# EasyEDA Pro project C108_STM32.eprj, board PCB2
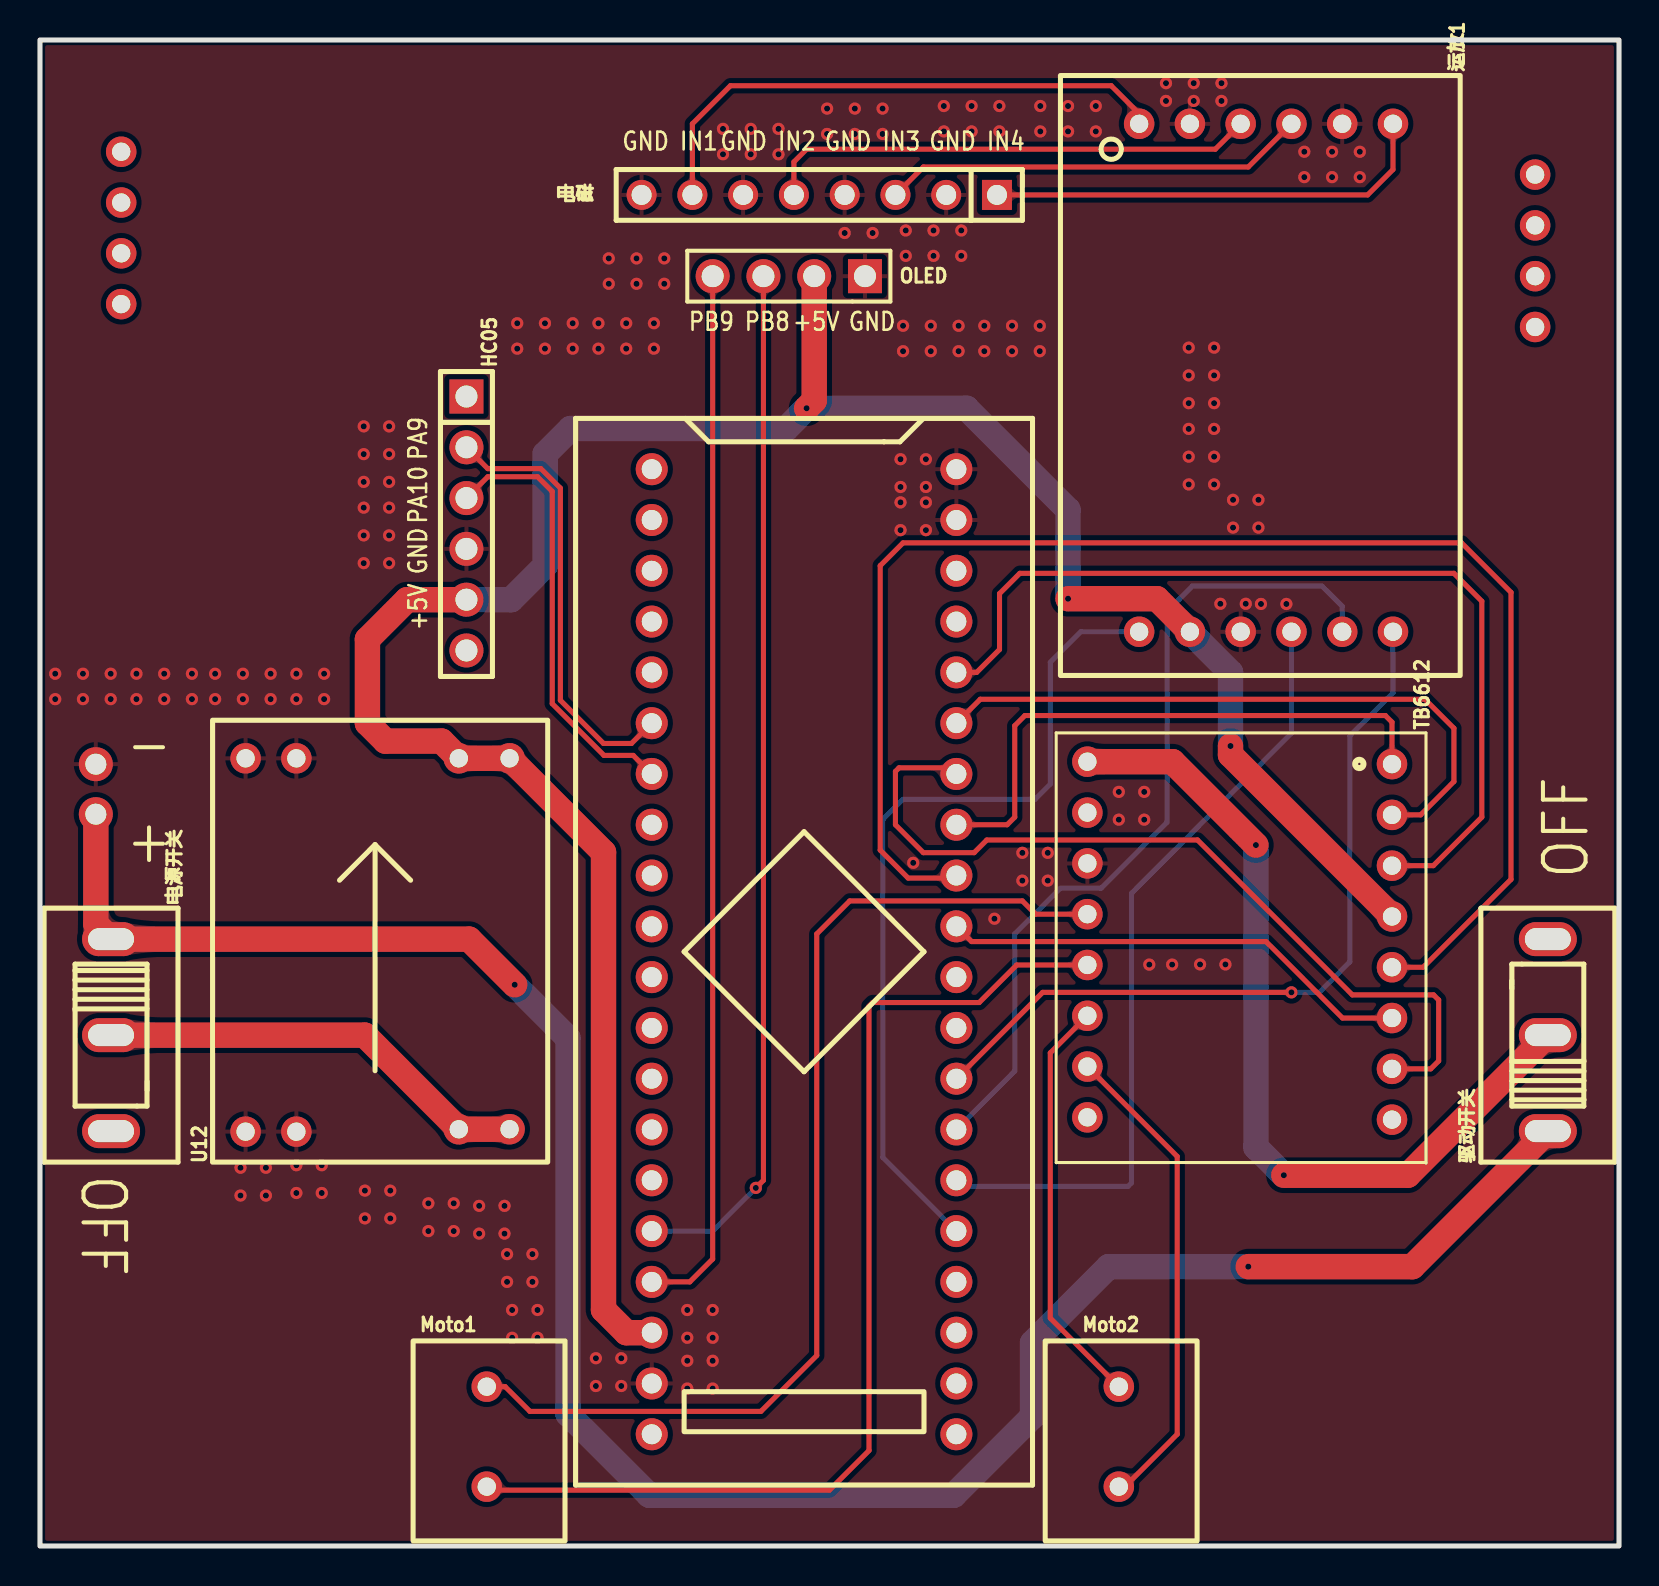
[diagram p11: board, top side]
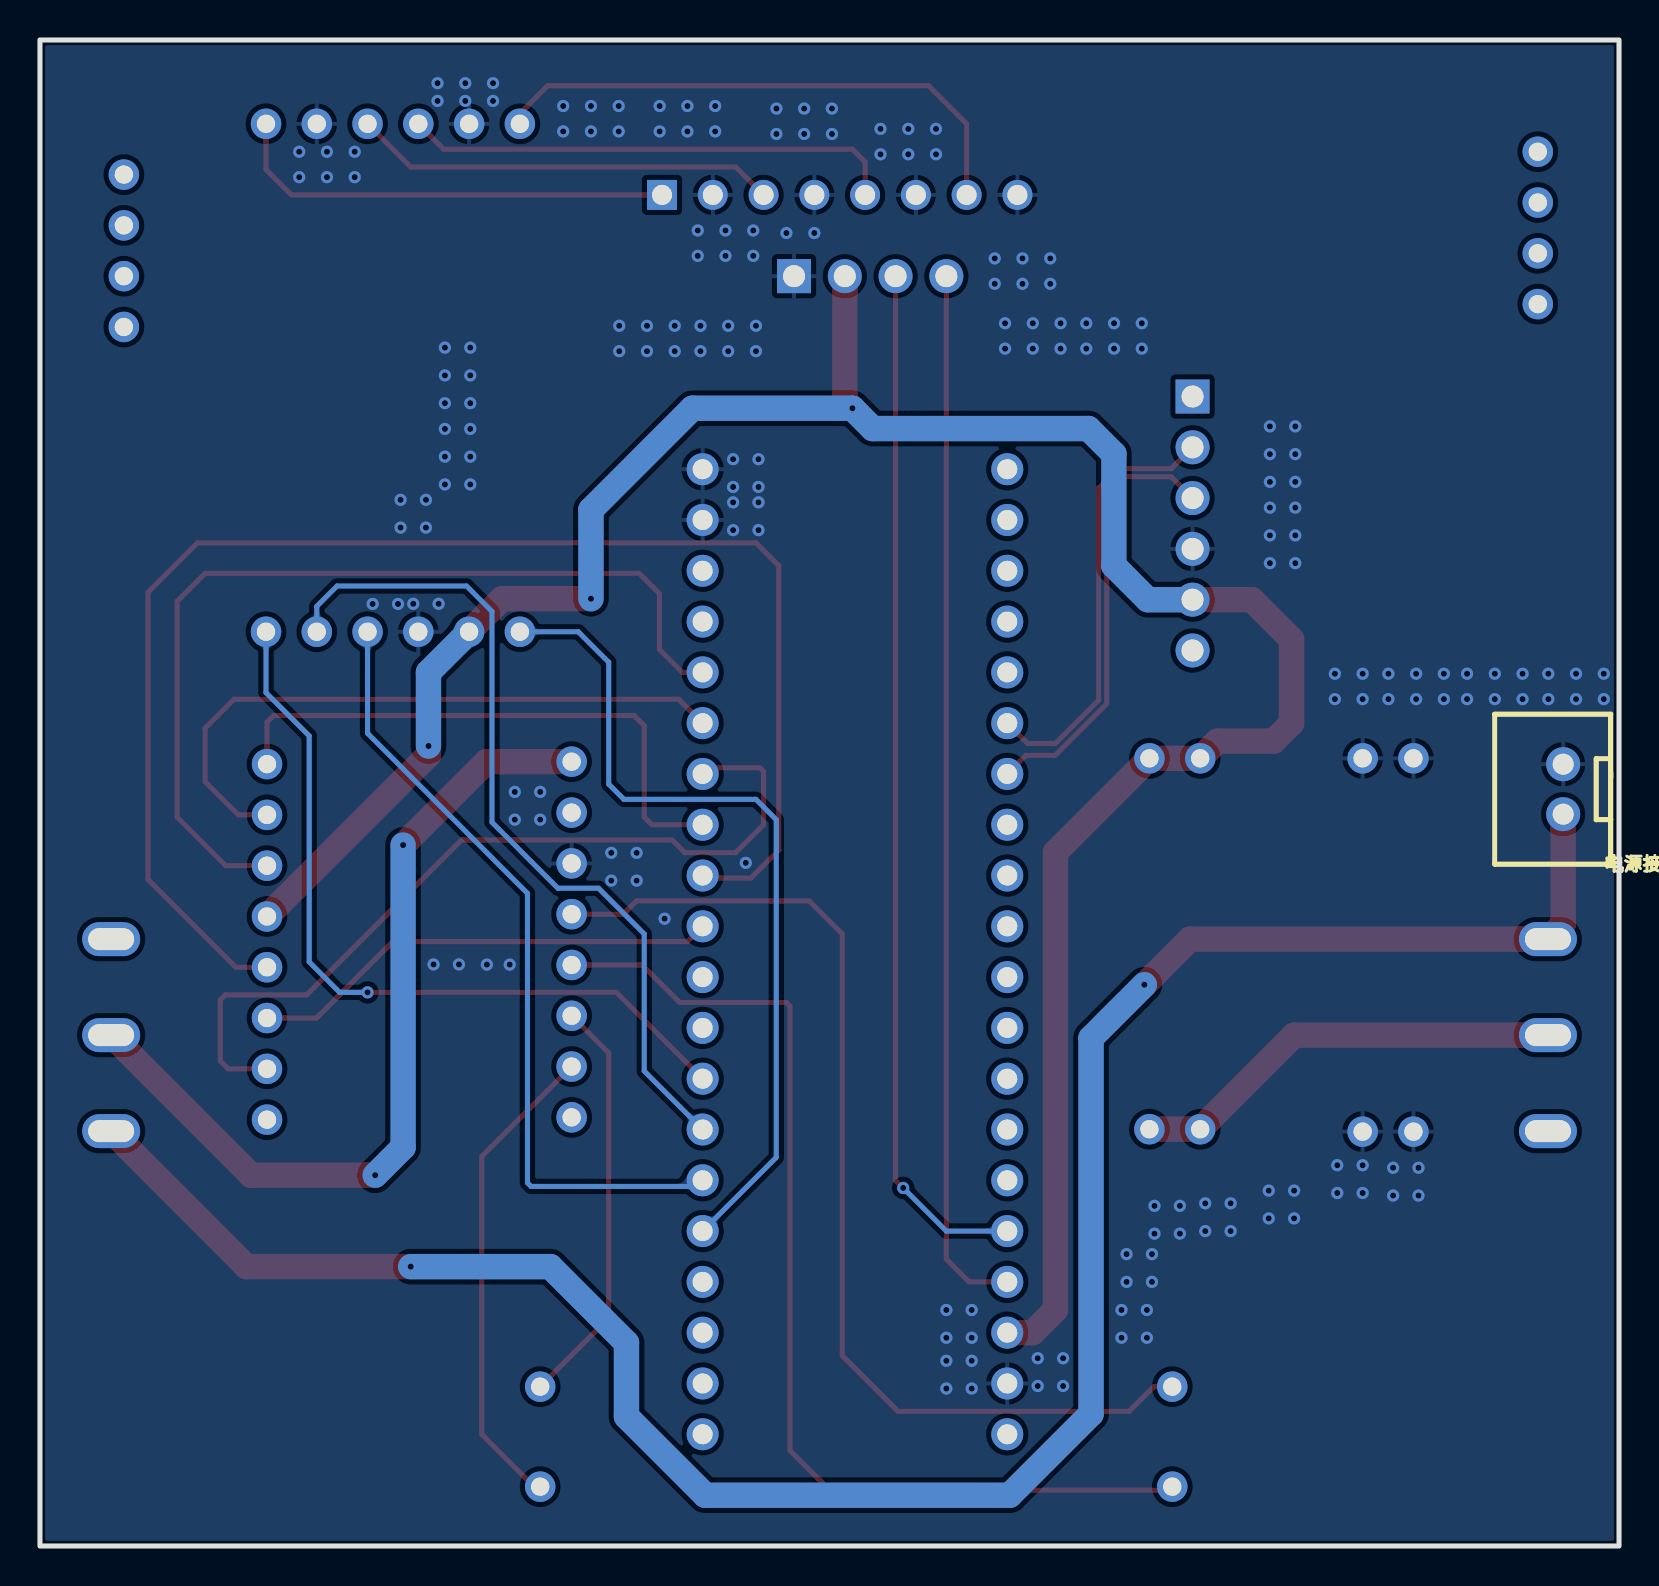
[diagram p12: board, bottom side, seen from below]

Outline 79 x 75.31 mm; copper layers: Top Layer, Bottom Layer. Coordinates in mm from the lower left corner of the outline.
Outline path: rectangle 0,75.31 79,0
Stack: Top Layer 0.035mm / Dielectric1 1.51mm FR4 er 4.5 / Bottom Layer 0.035mm

## Design rules (mm)
net PA9: DP1
net PA10: DP1
template: JLCPCB Capability(Two Layers Board)
spacing copperThickness1oz (default): track to track 0.102, other pairs 0.152 to 0.3
spacing copperThickness2oz: track to track 0.203, other pairs 0.152 to 0.3
track width copperThickness1oz (default): min 0.127, default 0.254, max 2.54
track width copperThickness2oz: min 0.203, default 0.254, max 2.54
differential pair differentialPair (default): width min 0.127, default 0.254, max 2.54; gap min 0.152, default 0.152
via viaSize (default): diameter min 0.5, default 0.61, max 10; hole min 0.3, default 0.305, max 6.3

## Placement (name value [footprint] x y rotation side)
HC05  HC05  [HDR-TH_6P-P2.54-V-M]  21.34 51.13 270 top
Moto1  -  [端子]  18.54 10.13 270 top
Moto2  -  [端子]  50.17 10.13 270 top
NOREF  -  [Pad_e28]  74.8 68.58 0 top
NOREF#2  -  [Pad_e19]  4.06 67.18 0 top
NOREF#3  -  [Pad_e20]  4.06 64.64 0 top
NOREF#4  -  [Pad_e18]  4.06 69.72 0 top
NOREF#5  -  [Pad_e30]  74.8 63.5 0 top
NOREF#6  -  [Pad_e22]  4.06 62.1 0 top
NOREF#7  -  [Pad_e29]  74.8 60.96 0 top
NOREF#8  -  [Pad_e31]  74.8 66.04 0 top
OLED  0.96 OLED  [HDR-TH_4P-P2.54-V-M-1]  37.46 63.5 180 top
TB6612  -  [TB6612_Board]  59.69 42.16 270 top
U1  STM32F103C8T6-Card  [CONN-TH_L53.3-W22.9_STM32F103C8T6-CARD]  38.23 29.72 270 top
U12  -  [降压mini]  16.38 30.5 90 top
电源开关  电源开关  [SW-TH_SHOU-HAN_SS12D10G4]  3.56 25.55 270 top
电源接口  XH2.54*2P_直插  [CONN-TH_2P-P2.50-XH2.54-2P]  2.79 37.85 270 bottom
电磁  电感  [HDR-TH_8P-P2.54-V-M]  38.99 67.56 180 top
运放1  -  [逐飞运放]  50.93 73.66 270 top
驱动开关  驱动开关  [SW-TH_SHOU-HAN_SS12D10G4]  75.44 25.55 90 top

## Footprints (pads in the part's own frame, mm; a bottom-side part is the same pattern mirrored in y, then rotated)
CONN-TH_2P-P2.50-XH2.54-2P
  round 1.7 hole 1.05: 1(1.25,0) 2(-1.25,0)
CONN-TH_L53.3-W22.9_STM32F103C8T6-CARD
  round 1.6 hole 1: 1(-24.13,-7.62) 2(-21.59,-7.62) 3(-19.05,-7.62) 4(-16.51,-7.62) 5(-13.97,-7.62) 6(-11.43,-7.62) 7(-8.89,-7.62) 8(-6.35,-7.62) 9(-3.81,-7.62) 10(-1.27,-7.62) 11(1.27,-7.62) 12(3.81,-7.62) 13(6.35,-7.62) 14(8.89,-7.62) 15(11.43,-7.62) 16(13.97,-7.62) 17(16.51,-7.62) 18(19.05,-7.62) 19(21.59,-7.62) 20(24.13,-7.62) 21(24.13,7.62) 22(21.59,7.62) 23(19.05,7.62) 24(16.51,7.62) 25(13.97,7.62) 26(11.43,7.62) 27(8.89,7.62) 28(6.35,7.62) 29(3.81,7.62) 30(1.27,7.62) 31(-1.27,7.62) 32(-3.81,7.62) 33(-6.35,7.62) 34(-8.89,7.62) 35(-11.43,7.62) 36(-13.97,7.62) 37(-16.51,7.62) 38(-19.05,7.62) 39(-21.59,7.62) 40(-24.13,7.62)
HDR-TH_4P-P2.54-V-M-1
  rect 1.7x1.7 hole 1.1: 1(-3.81,0)
  round 1.7 hole 1.1: 2(-1.27,0) 3(1.27,0) 4(3.81,0)
HDR-TH_6P-P2.54-V-M
  rect 1.7x1.7 hole 1.1: 1(-6.35,0)
  round 1.7 hole 1.1: 2(-3.81,0) 3(-1.27,0) 4(1.27,0) 5(3.81,0) 6(6.35,0)
HDR-TH_8P-P2.54-V-M
  rect 1.5x1.5 hole 1: 1(-8.89,0)
  round 1.5 hole 1: 2(-6.35,0) 3(-3.81,0) 4(-1.27,0) 5(1.27,0) 6(3.81,0) 7(6.35,0) 8(8.89,0)
Pad_e18
  round 1.524 hole 0.914: 1(0,0)
Pad_e19
  round 1.524 hole 0.914: 2(0,0)
Pad_e20
  round 1.524 hole 0.914: 3(0,0)
Pad_e22
  round 1.524 hole 0.914: 4(0,0)
Pad_e28
  round 1.524 hole 0.914: 1(0,0)
Pad_e29
  round 1.524 hole 0.914: 4(0,0)
Pad_e30
  round 1.524 hole 0.914: 3(0,0)
Pad_e31
  round 1.524 hole 0.914: 2(0,0)
SW-TH_SHOU-HAN_SS12D10G4
  oval 1.7x2.9 hole 1.1x2.3: 1(-4.8,0) 2(0,0) 3(4.8,0)
TB6612_Board
  round 1.524 hole 0.914: 1(3.063,7.952) 2(5.603,7.952) 3(8.143,7.952) 4(10.683,7.952) 5(13.223,7.952) 6(15.763,7.952) 7(18.303,7.952) 8(20.843,7.952) 9(20.729,-7.288) 10(18.189,-7.288) 11(15.649,-7.288) 12(13.108,-7.288) 13(10.569,-7.288) 14(8.028,-7.288) 15(5.489,-7.288) 16(2.942,-7.288)
端子
  round 1.524 hole 0.914: 1(2.159,3.81) 2(7.159,3.81)
逐飞运放
  round 1.524 hole 0.914: 1(2.54,4.064) 2(2.54,6.604) 3(2.54,9.144) 4(2.54,11.684) 5(2.54,14.224) 6(2.54,16.764) 7(27.94,4.064) 8(27.94,6.604) 9(27.94,9.144) 10(27.94,11.684) 11(27.94,14.224) 12(27.94,16.764)
降压mini
  round 1.524 hole 0.914: 1(-9.779,6.096) 2(-9.779,3.556) 3(-9.659,-4.571) 4(-9.656,-7.112) 5(8.89,6.096) 6(8.89,3.556) 7(8.89,-4.571) 8(8.89,-7.112)

## Nets
As in the schematic, except:
GND: HC05.4 OLED.1 TB6612.14 U1.19 U1.39 U1.40 U12.1 U12.2 U12.5 U12.6 电源接口.2 电磁.2 电磁.4 电磁.6 电磁.8 运放1.2 运放1.5 运放1.9
$1N871: Moto1.2 TB6612.12
$1N884: 电磁.7 运放1.1
$1N885: 电磁.5 运放1.3
$1N886: 电磁.3 运放1.4
$1N887: 电磁.1 运放1.6
$1N1112: U12.3 U12.4 电源开关.2

Pads without a net: HC05 1 6; NOREF 1; NOREF#2 2; NOREF#3 3; NOREF#4 1; NOREF#5 3; NOREF#6 4; NOREF#7 4; NOREF#8 2; TB6612 8 9 15; U1 20 21 37 38; 电源开关 3; 驱动开关 3

## Via types
v1: diameter 0.61, hole 0.305, Top Layer to Bottom Layer, 199 vias

## Routing (per net, layer and track width the routed paths; a pad name or vN(x,y) marks a point on that pad's centre or on a via; arc(x,y) is an arc through that point)
12V+: length 110.7
  Top Layer w1.27: 驱动开关.1 68.66,13.97 v1(60.45,13.97) ; 电源接口.1 2.79,31.11 电源开关.1 21.47,30.35 v1(23.75,28.07)
  Bottom Layer w1.27: v1(23.75,28.07) 26.42,25.4 26.42,6.6 30.48,2.54 45.72,2.54 49.66,6.48 49.66,10.16 53.47,13.97 v1(60.45,13.97)
+5V: length 126.1
  Top Layer w1.27: U1.18 29.34,10.67 28.19,11.81 28.19,34.69 U12.8 U12.7 20.09,40.25 17.28,40.25 16.38,41.15 16.38,45.34 18.37,47.32 HC05.5 ; 57.53,45.72 55.88,47.37 v1(51.43,47.37) ; OLED.2 38.73,57.28 v1(38.35,56.9) ; TB6612.4 59.56,39.56 v1(59.56,40)
  Bottom Layer w1.27: 57.53,45.72 59.56,43.69 v1(59.56,40) ; v1(51.43,47.37) 51.43,51.82 46.36,56.9 v1(38.35,56.9) 37.34,55.88 26.54,55.88 25.27,54.61 25.27,49.02 23.57,47.32 HC05.5
GND:
  vias: v1(0.76,43.62) v1(0.76,42.35) v1(2.15,43.62) v1(2.15,42.35) v1(3.54,43.62) v1(3.54,42.35) v1(4.83,43.62) v1(4.83,42.35) v1(6.21,43.62) v1(6.21,42.35) v1(7.6,43.62) v1(7.6,42.35) v1(8.76,43.62) v1(8.76,42.35) v1(10.03,18.91) v1(10.03,17.53) v1(10.15,43.62) v1(10.15,42.35) v1(11.3,18.91) v1(11.3,17.53) v1(11.54,43.62) v1(11.54,42.35) v1(12.83,43.62) v1(12.83,42.35) v1(12.83,19.04) v1(12.83,17.65) v1(14.1,19.04) v1(14.1,17.65) v1(14.22,43.62) v1(14.22,42.35) v1(16.2,55.99) v1(16.2,54.6) v1(16.2,53.21) v1(16.2,51.93) v1(16.2,50.54) v1(16.2,49.15) v1(16.26,17.77) v1(16.26,16.38) v1(17.47,55.99) v1(17.47,54.6) v1(17.47,53.21) v1(17.47,51.93) v1(17.47,50.54) v1(17.47,49.15) v1(17.53,17.77) v1(17.53,16.38) v1(19.43,17.14) v1(19.43,15.75) v1(20.7,17.14) v1(20.7,15.75) v1(21.97,17.01) v1(21.97,15.62) v1(23.24,17.01) v1(23.24,15.62) v1(23.37,14.6) v1(23.37,13.21) v1(23.62,11.8) v1(23.62,10.41) v1(23.88,61.15) v1(23.88,59.88) v1(24.64,14.6) v1(24.64,13.21) v1(24.89,11.8) v1(24.89,10.41) v1(25.26,61.15) v1(25.26,59.88) v1(26.65,61.15) v1(26.65,59.88) v1(27.81,9.39) v1(27.81,8) v1(27.94,61.15) v1(27.94,59.88) v1(28.46,64.39) v1(28.46,63.12) v1(29.08,9.39) v1(29.08,8) v1(29.33,61.15) v1(29.33,59.88) v1(29.84,64.39) v1(29.84,63.12) v1(30.72,61.15) v1(30.72,59.88) v1(31.23,64.39) v1(31.23,63.12) v1(32.39,11.8) v1(32.39,10.41) v1(32.39,9.26) v1(32.39,7.87) v1(33.65,11.8) v1(33.65,10.41) v1(33.65,9.26) v1(33.65,7.87) v1(34.17,70.87) v1(34.17,69.6) v1(35.56,70.87) v1(35.56,69.6) v1(36.95,70.87) v1(36.95,69.6) v1(39.38,71.88) v1(39.38,70.61) v1(40.26,65.66) v1(40.77,71.88) v1(40.77,70.61) v1(41.66,65.66) v1(42.16,71.88) v1(42.16,70.61) v1(43.05,54.35) v1(43.05,52.96) v1(43.05,52.19) v1(43.05,50.8) v1(43.18,61.02) v1(43.18,59.75) v1(43.32,65.79) v1(43.32,64.52) v1(43.69,34.16) v1(44.32,54.35) v1(44.32,52.96) v1(44.32,52.19) v1(44.32,50.8) v1(44.57,61.02) v1(44.57,59.75) v1(44.7,65.79) v1(44.7,64.52) v1(45.22,72.01) v1(45.22,70.74) v1(45.96,61.02) v1(45.96,59.75) v1(46.09,65.79) v1(46.09,64.52) v1(46.61,72.01) v1(46.61,70.74) v1(47.24,61.02) v1(47.24,59.75) v1(47.75,31.37) v1(48,72.01) v1(48,70.74) v1(48.63,61.02) v1(48.63,59.75) v1(49.15,34.66) v1(49.15,33.27) v1(50.05,72.01) v1(50.05,70.74) v1(50.02,61.02) v1(50.02,59.75) v1(50.42,34.66) v1(50.42,33.27) v1(51.43,72.01) v1(51.43,70.74) v1(52.82,72.01) v1(52.82,70.74) v1(53.97,37.71) v1(53.97,36.32) v1(55.24,37.71) v1(55.24,36.32) v1(55.5,29.07) v1(56.33,73.15) v1(56.33,72.26) v1(56.64,29.07) v1(57.47,59.93) v1(57.47,58.54) v1(57.47,57.15) v1(57.47,55.86) v1(57.47,54.47) v1(57.47,53.09) v1(57.72,73.15) v1(57.72,72.26) v1(58.04,29.08) v1(58.74,59.93) v1(58.74,58.54) v1(58.74,57.15) v1(58.74,55.86) v1(58.74,54.47) v1(58.74,53.09) v1(59.05,47.12) v1(59.11,73.15) v1(59.11,72.26) v1(59.31,29.08) v1(59.69,52.32) v1(59.69,50.93) v1(60.33,47.12) v1(60.96,52.32) v1(60.96,50.93) v1(61.09,47.11) v1(62.36,47.11) v1(63.25,69.72) v1(63.25,68.45) v1(64.64,69.72) v1(64.64,68.45) v1(66.03,69.72) v1(66.03,68.45)
PA0: length 42.4
  Bottom Layer w0.254: 运放1.7 52.07,45.72 50.55,44.2 50.55,38.1 49.78,37.34 43.18,37.34 42.16,36.32 42.16,19.43 U1.25
PA1: length 39.8
  Bottom Layer w0.254: 运放1.10 62.61,40.64 54.61,32.64 54.61,18.16 54.43,17.98 46.15,17.98 U1.26
PA2: length 42.4
  Bottom Layer w0.254: U1.27 48.77,23.75 48.77,30.61 51.05,32.89 53.09,32.89 56.39,36.19 56.39,46.74 57.66,48.01 64.14,48.01 65.15,46.99 运放1.11
PA3: length 39.5
  Top Layer w0.254: U1.28 50.17,27.69 v1(62.61,27.69)
  Bottom Layer w0.254: v1(62.61,27.69) 64.01,27.69 65.53,29.21 65.53,40.51 67.69,42.67 67.69,45.72
PA6: length 23.7
  Top Layer w0.254: U1.31 46.61,30.23 61.34,30.23 65.17,26.4 TB6612.6
PA7: length 73.9
  Top Layer w0.254: U1.32 45.72,33.4 43.43,33.4 42.04,34.8 42.04,49.02 43.18,50.16 71.12,50.16 73.6,47.69 73.6,33.34 69.2,28.94 TB6612.5
PA9: length 22
  Top Layer w0.254: U1.6 29.59,40.13 28.19,40.13 26.03,42.29 26.03,52.9 25.06,53.88 22.4,53.88 HC05.2
PA10: length 22.1
  Top Layer w0.254: U1.7 29.68,39.53 28.22,39.53 25.63,42.12 25.63,52.73 24.89,53.47 22.4,53.47 HC05.3
PB0: length 29
  Top Layer w0.254: TB6612.1 67.64,41.2 67.31,41.53 49.28,41.53 48.77,41.02 48.77,36.45 48.39,36.07 U1.33
PB1: length 42.8
  Top Layer w0.254: TB6612.7 69.58,23.86 69.98,24.26 69.98,27.3 69.72,27.56 65.66,27.56 57.91,35.31 47.37,35.31 46.74,34.67 44.2,34.67 42.8,36.07 42.8,38.73 42.98,38.91 45.54,38.91 U1.34
PB8: length 51.9
  Top Layer w0.254: v1(35.81,17.91) 36.2,18.29 OLED.3
  Bottom Layer w0.254: v1(35.81,17.91) 33.65,15.75 U1.16
PB9: length 52.7
  Top Layer w0.254: U1.17 32.51,13.21 33.65,14.35 OLED.4
PB10: length 32.4
  Top Layer w0.254: TB6612.2 69.07,36.56 70.74,38.23 70.74,40.89 69.29,42.34 47.04,42.34 U1.35
PB11: length 46.9
  Top Layer w0.254: TB6612.3 69.71,34.02 72.14,36.45 72.14,47.24 70.74,48.64 49.02,48.64 48.01,47.62 48.01,44.83 46.86,43.69 U1.36
$1N870: length 53.8
  Top Layer w0.254: TB6612.13 49.81,31.6 49.15,32.26 40.51,32.26 38.86,30.61 38.86,9.52 36.07,6.73 24.51,6.73 23.27,7.97 Moto1.1
$1N871: length 54
  Top Layer w0.254: TB6612.12 48.87,29.06 46.99,27.18 41.66,27.18 41.48,27 41.48,4.77 39.5,2.79 22.53,2.79 Moto1.2
$1N872: length 20.7
  Top Layer w0.254: Moto2.1 50.55,11.4 50.55,24.66 TB6612.11
$1N873: length 24.3
  Top Layer w0.254: Moto2.2 54.28,2.97 56.9,5.59 56.9,19.48 TB6612.10
$1N884: length 27.8
  Top Layer w0.254: 电磁.7 32.64,71.12 34.54,73.02 53.59,73.02 54.99,71.63 运放1.1
$1N885: length 24.8
  Top Layer w0.254: 电磁.5 37.72,69.21 38.35,69.85 58.8,69.85 60.07,71.12
$1N886: length 21.3
  Top Layer w0.254: 运放1.4 60.45,68.96 44.2,68.96 电磁.3
$1N887: length 22.6
  Top Layer w0.254: 电磁.1 66.42,67.56 67.69,68.83 67.69,71.12
$1N1112: length 21.9
  Top Layer w1.27: 电源开关.2 16.25,25.55 U12.3 23.49,20.84 U12.4
$1N1138: length 43.4
  Top Layer w1.27: 驱动开关.2 68.43,18.54 v1(62.23,18.54) ; v1(60.83,35.05) 56.66,39.22 TB6612.16
  Bottom Layer w1.27: v1(60.83,35.05) 60.83,19.94 v1(62.23,18.54)

## Copper pours and planes (outline as drawn; the poured copper is in the pictures)
GND on Top Layer: -7.37,79.25 89.03,79.25 89.03,-9.65 -7.37,-9.65
GND on Bottom Layer: -12.32,84.33 92.08,84.33 92.08,-12.7 -12.32,-12.7

Small or netless copper shapes (teardrops, artwork), in the pictures only: 55 on Top Layer, 12 on Bottom Layer

## Text on the board
Top Silkscreen Layer: GND | IN1 | IN2 | IN3 | IN4 | PA9 | PA10 | +5V | PB9 | PB8 | - | + | OFF
